# EasyEDA Pro project wukong01-Y003-HTOL - 2.eprj, board PCB1 (continued)
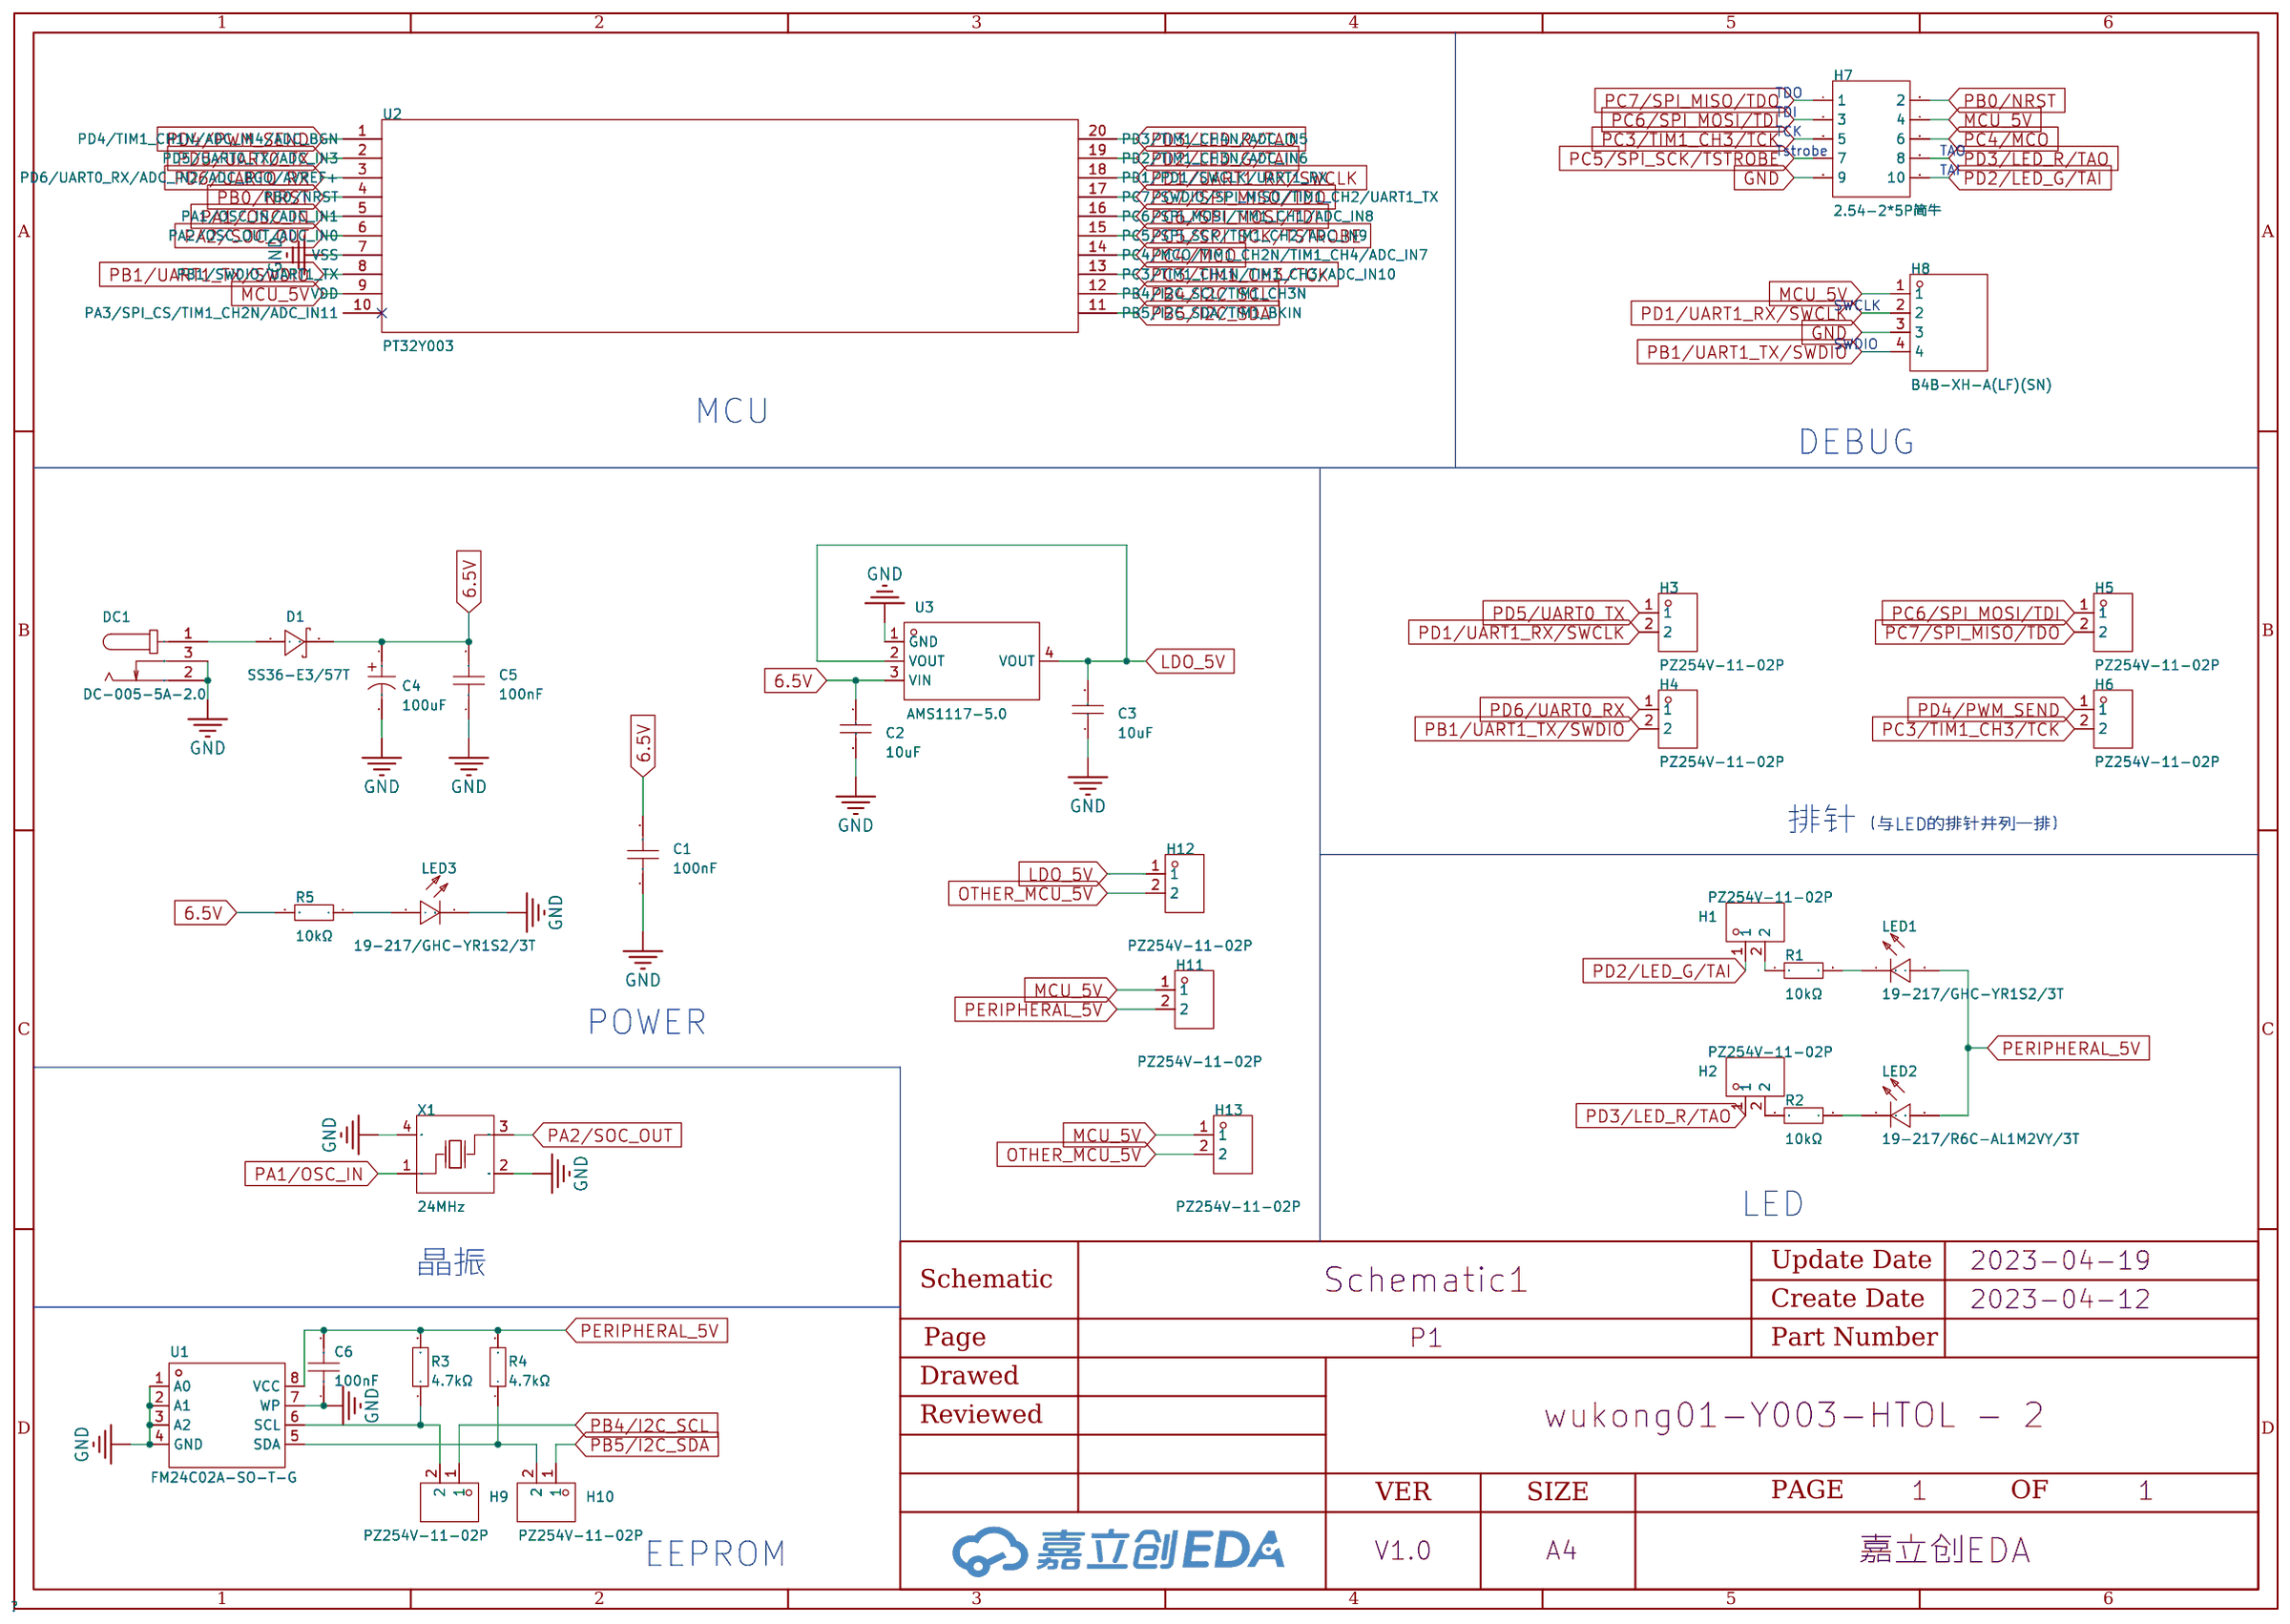
[diagram p0: schematic sheet]
## Routing (per net, layer and track width the routed paths; a pad name or vN(x,y) marks a point on that pad's centre or on a via; arc(x,y) is an arc through that point) (continued)
  Top Layer w0.254: U2#27.14 262.58,58.57 v1(269.32,58.57) ; v1(89.32,96.57) 82.58,96.57 U2#17.14 ; H7#12.6 124.67,141.81 v1(134.32,141.81) ; U2#32.14 217.58,20.57 v1(224.32,20.57) ; H7#13.6 169.67,141.81 v1(179.32,141.81) ; v1(44.32,103.8) 34.67,103.8 H7#21.6 ; v1(89.32,134.57) 82.58,134.57 U2#11.14 ; v1(134.32,210.57) 127.58,210.57 U2#2.14 ; 169.67,31.87 169.67,27.81 v1(179.32,27.81) ; U2#8.14 217.58,172.57 v1(224.32,172.57) ; v1(269.32,103.8) 259.67,103.8 H7#22.6 ; v1(89.32,210.57) 82.58,210.57 U2.14 ; H7#10.6 259.67,179.81 v1(269.32,179.81) ; v1(89.32,27.81) 79.67,27.81 79.67,31.87 ; H7#9.6 34.67,179.81 v1(44.32,179.81) ; H7#16.6 259.67,141.81 v1(269.32,141.81) ; v1(269.32,172.57) 262.58,172.57 U2#9.14 ; U2#31.14 172.58,20.57 v1(179.32,20.57) ; v1(44.32,141.81) 34.67,141.81 H7#15.6 ; H7#8.6 214.67,179.81 v1(224.32,179.81) ; v1(44.32,65.81) 34.67,65.81 34.67,69.87 ; v1(179.32,172.57) 172.58,172.57 U2#7.14 ; v1(224.32,58.57) 217.58,58.57 U2#26.14 ; H7#11.6 79.67,141.81 v1(89.32,141.81) ; v1(134.32,179.81) 124.67,179.81 H7#6.6 ; v1(179.32,58.57) 172.58,58.57 U2#25.14 ; v1(89.32,20.57) 82.58,20.57 U2#29.14 ; U2#6.14 127.58,172.57 v1(134.32,172.57) ; v1(89.32,103.8) 79.67,103.8 H7#17.6 ; v1(89.32,65.81) 79.67,65.81 79.67,69.87 ; v1(44.32,172.57) 37.58,172.57 U2#10.14 ; 169.67,221.87 169.67,217.81 v1(179.32,217.81) ; v1(224.32,65.81) 214.67,65.81 214.67,69.87 ; v1(179.32,96.57) 172.58,96.57 U2#19.14 ; v1(134.32,134.57) 127.58,134.57 U2#12.14 ; 79.67,221.87 79.67,217.81 v1(89.32,217.81) ; v1(44.32,96.57) 37.58,96.57 U2#22.14 ; v1(269.32,96.57) 262.58,96.57 U2#21.14 ; v1(224.32,217.81) 214.67,217.81 214.67,221.87 ; U2#4.14 217.58,210.57 v1(224.32,210.57) ; U2#23.14 82.58,58.57 v1(89.32,58.57) ; 124.67,31.87 124.67,27.81 v1(134.32,27.81) ; U2#18.14 127.58,96.57 v1(134.32,96.57) ; U2#24.14 127.58,58.57 v1(134.32,58.57) ; H7#19.6 169.67,103.8 v1(179.32,103.8) ; v1(44.32,58.57) 37.58,58.57 U2#28.14 ; v1(179.32,134.57) 172.58,134.57 U2#13.14 ; U2#20.14 217.58,96.57 v1(224.32,96.57) ; v1(179.32,179.81) 169.67,179.81 H7#7.6 ; v1(179.32,210.57) 172.58,210.57 U2#3.14 ; U2#14.14 217.58,134.57 v1(224.32,134.57) ; v1(134.32,217.81) 124.67,217.81 124.67,221.87 ; v1(224.32,27.81) 214.67,27.81 214.67,31.87 ; v1(89.32,172.57) 82.58,172.57 U2#5.14 ; v1(269.32,134.57) 262.58,134.57 U2#15.14 ; 259.67,69.87 259.67,65.81 v1(269.32,65.81) ; v1(134.32,65.81) 124.67,65.81 124.67,69.87 ; v1(134.32,20.57) 127.58,20.57 U2#30.14 ; v1(224.32,141.81) 214.67,141.81 H7#14.6 ; v1(179.32,65.81) 169.67,65.81 169.67,69.87 ; H7#18.6 124.67,103.8 v1(134.32,103.8) ; v1(89.32,179.81) 79.67,179.81 H7#5.6 ; U2#16.14 37.58,134.57 v1(44.32,134.57) ; H7#20.6 214.67,103.8 v1(224.32,103.8)
  Bottom Layer w0.254: v1(44.32,65.81) v1(44.32,58.57) ; v1(134.32,217.81) v1(134.32,210.57) ; v1(44.32,103.8) v1(44.32,96.57) ; v1(224.32,141.81) v1(224.32,134.57) ; v1(44.32,179.81) v1(44.32,172.57) ; v1(179.32,141.81) v1(179.32,134.57) ; v1(134.32,179.81) v1(134.32,172.57) ; v1(179.32,179.81) v1(179.32,172.57) ; v1(269.32,141.81) v1(269.32,134.57) ; v1(269.32,179.81) v1(269.32,172.57) ; v1(89.32,141.81) v1(89.32,134.57) ; v1(44.32,141.81) v1(44.32,134.57) ; v1(224.32,179.81) v1(224.32,172.57) ; v1(224.32,65.81) v1(224.32,58.57) ; v1(134.32,27.81) v1(134.32,20.57) ; v1(89.32,217.81) v1(89.32,210.57) ; v1(134.32,141.81) v1(134.32,134.57) ; v1(179.32,65.81) v1(179.32,58.57) ; v1(224.32,27.81) v1(224.32,20.57) ; v1(134.32,103.8) v1(134.32,96.57) ; v1(224.32,103.8) v1(224.32,96.57) ; v1(179.32,27.81) v1(179.32,20.57) ; v1(134.32,65.81) v1(134.32,58.57) ; v1(89.32,65.81) v1(89.32,58.57) ; v1(89.32,103.8) v1(89.32,96.57) ; v1(269.32,65.81) v1(269.32,58.57) ; v1(179.32,217.81) v1(179.32,210.57) ; v1(269.32,103.8) v1(269.32,96.57) ; v1(179.32,103.8) v1(179.32,96.57) ; v1(89.32,179.81) v1(89.32,172.57) ; v1(89.32,27.81) v1(89.32,20.57) ; v1(224.32,217.81) v1(224.32,210.57)
PC5/SPI_SCK/TSTROBE: length 1132
  Top Layer w0.254: v1(178.69,211.2) 172.6,211.2 U2#3.15 ; U2#8.15 217.6,173.2 v1(223.69,173.2) ; v1(268.69,135.2) 262.6,135.2 U2#15.15 ; v1(133.69,211.2) 127.6,211.2 U2#2.15 ; U2#17.15 82.6,97.2 v1(88.69,97.2) ; U2#9.15 262.6,173.2 v1(268.69,173.2) ; U2#30.15 127.6,21.2 v1(133.69,21.2) ; U2#11.15 82.6,135.2 v1(88.69,135.2) ; v1(133.69,173.2) 127.6,173.2 U2#6.15 ; U2#32.15 217.6,21.2 v1(223.69,21.2) ; U2.15 82.6,211.2 v1(88.69,211.2) ; U2#24.15 127.6,59.2 v1(133.69,59.2) ; U2#23.15 82.6,59.2 v1(88.69,59.2) ; U2#29.15 82.6,21.2 v1(88.69,21.2) ; v1(43.69,97.2) 37.6,97.2 U2#22.15 ; v1(223.69,211.2) 217.6,211.2 U2#4.15 ; v1(43.69,135.2) 37.6,135.2 U2#16.15 ; v1(133.69,135.2) 127.6,135.2 U2#12.15 ; U2#31.15 172.6,21.2 v1(178.69,21.2) ; v1(178.69,97.2) 172.6,97.2 U2#19.15 ; v1(178.69,135.2) 172.6,135.2 U2#13.15 ; v1(268.69,97.2) 262.6,97.2 U2#21.15 ; v1(43.69,59.2) 37.6,59.2 U2#28.15 ; U2#20.15 217.6,97.2 v1(223.69,97.2) ; U2#10.15 37.6,173.2 v1(43.69,173.2) ; v1(178.69,173.2) 172.6,173.2 U2#7.15 ; U2#26.15 217.6,59.2 v1(223.69,59.2) ; v1(133.69,97.2) 127.6,97.2 U2#18.15 ; U2#14.15 217.6,135.2 v1(223.69,135.2) ; U2#27.15 262.6,59.2 v1(268.69,59.2) ; U2#5.15 82.6,173.2 v1(88.69,173.2) ; v1(178.69,59.2) 172.6,59.2 U2#25.15
  Bottom Layer w0.254: v1(178.69,59.2) 178.69,74.31 177.93,75.08 167.89,75.08 167.13,74.31 H7#25.7 ; v1(178.69,97.2) 178.69,112.31 177.93,113.08 167.89,113.08 167.13,112.31 H7#19.7 ; v1(133.69,59.2) 133.69,74.31 132.93,75.08 122.89,75.08 122.13,74.31 H7#24.7 ; H7#13.7 167.13,150.31 167.89,151.08 177.93,151.08 178.69,150.31 v1(178.69,135.2) ; H7#5.7 77.13,188.31 77.89,189.08 87.93,189.08 88.69,188.31 v1(88.69,173.2) ; H7#29.7 77.13,36.31 77.89,37.08 87.93,37.08 88.69,36.31 v1(88.69,21.2) ; v1(43.69,173.2) 43.69,188.31 42.93,189.08 32.89,189.08 32.13,188.31 H7#9.7 ; H7#17.7 77.13,112.31 77.89,113.08 87.93,113.08 88.69,112.31 v1(88.69,97.2) ; H7#26.7 212.13,74.31 212.89,75.08 222.93,75.08 223.69,74.31 v1(223.69,59.2) ; v1(43.69,135.2) 43.69,150.31 42.93,151.08 32.89,151.08 32.13,150.31 H7#15.7 ; H7#20.7 212.13,112.31 212.89,113.08 222.93,113.08 223.69,112.31 v1(223.69,97.2) ; v1(268.69,135.2) 268.69,150.31 267.93,151.08 257.89,151.08 257.13,150.31 H7#16.7 ; v1(88.69,59.2) 88.69,74.31 87.93,75.08 77.89,75.08 77.13,74.31 H7#23.7 ; H7#8.7 212.13,188.31 212.89,189.08 222.93,189.08 223.69,188.31 v1(223.69,173.2) ; H7.7 77.13,226.31 77.89,227.08 87.93,227.08 88.69,226.31 v1(88.69,211.2) ; v1(178.69,173.2) 178.69,188.31 177.93,189.08 167.89,189.08 167.13,188.31 H7#7.7 ; H7#21.7 32.13,112.31 32.89,113.08 42.93,113.08 43.69,112.31 v1(43.69,97.2) ; v1(268.69,173.2) 268.69,188.31 267.93,189.08 257.89,189.08 257.13,188.31 H7#10.7 ; H7#14.7 212.13,150.31 212.89,151.08 222.93,151.08 223.69,150.31 v1(223.69,135.2) ; v1(223.69,211.2) 223.69,226.31 222.93,227.08 212.89,227.08 212.13,226.31 H7#4.7 ; H7#6.7 122.13,188.31 122.89,189.08 132.93,189.08 133.69,188.31 v1(133.69,173.2) ; H7#32.7 212.13,36.31 212.89,37.08 222.93,37.08 223.69,36.31 v1(223.69,21.2) ; H7#31.7 167.13,36.31 167.89,37.08 177.93,37.08 178.69,36.31 v1(178.69,21.2) ; v1(133.69,211.2) 133.69,226.31 132.93,227.08 122.89,227.08 122.13,226.31 H7#2.7 ; v1(133.69,21.2) 133.69,36.31 132.93,37.08 122.89,37.08 122.13,36.31 H7#30.7 ; v1(43.69,59.2) 43.69,74.31 42.93,75.08 32.89,75.08 32.13,74.31 H7#27.7 ; H7#12.7 122.13,150.31 122.89,151.08 132.93,151.08 133.69,150.31 v1(133.69,135.2) ; H7#11.7 77.13,150.31 77.89,151.08 87.93,151.08 88.69,150.31 v1(88.69,135.2) ; H7#22.7 257.13,112.31 257.89,113.08 267.93,113.08 268.69,112.31 v1(268.69,97.2) ; v1(268.69,59.2) 268.69,74.31 267.93,75.08 257.89,75.08 257.13,74.31 H7#28.7 ; H7#3.7 167.13,226.31 167.89,227.08 177.93,227.08 178.69,226.31 v1(178.69,211.2) ; H7#18.7 122.13,112.31 122.89,113.08 132.93,113.08 133.69,112.31 v1(133.69,97.2)
PC6/SPI_MOSI/TDI: length 1011.1
  Top Layer w0.254: U2#23.16 82.6,59.96 v1(88.05,59.96) 92.12,59.96 92.75,60.6 H5#25.1 ; H5#11.1 227.75,136.6 227.12,135.96 v1(223.05,135.96) 217.6,135.96 U2#14.16 ; U2#24.16 127.6,59.96 v1(133.05,59.96) 137.12,59.96 137.75,60.6 H5#24.1 ; U2#25.16 172.6,59.96 v1(178.05,59.96) 182.12,59.96 182.75,60.6 H5#26.1 ; H5#7.1 92.75,174.6 92.12,173.96 v1(88.05,173.96) 82.6,173.96 U2#5.16 ; U2#28.16 37.6,59.96 v1(43.05,59.96) 47.12,59.96 47.75,60.6 H5#28.1 ; U2#9.16 262.6,173.96 v1(268.05,173.96) 272.12,173.96 272.75,174.6 H5#9.1 ; U2#11.16 82.6,135.96 v1(88.05,135.96) 92.12,135.96 92.75,136.6 H5#13.1 ; H5#22.1 47.75,98.6 47.12,97.96 v1(43.05,97.96) 37.6,97.96 U2#22.16 ; H5#6.1 137.75,174.6 137.12,173.96 v1(133.05,173.96) 127.6,173.96 U2#6.16 ; H5#8.1 182.75,174.6 182.12,173.96 v1(178.05,173.96) 172.6,173.96 U2#7.16 ; U2#3.16 172.6,211.96 v1(178.05,211.96) 182.12,211.96 182.75,212.6 H5#4.1 ; U2#18.16 127.6,97.96 v1(133.05,97.96) 137.12,97.96 137.75,98.6 H5#18.1 ; U2#17.16 82.6,97.96 v1(88.05,97.96) 92.12,97.96 92.75,98.6 H5#19.1 ; U2#12.16 127.6,135.96 v1(133.05,135.96) 137.12,135.96 137.75,136.6 H5#12.1 ; U2#2.16 127.6,211.96 v1(133.05,211.96) 137.12,211.96 137.75,212.6 H5#3.1 ; U2#32.16 217.6,21.96 v1(223.05,21.96) 227.12,21.96 227.75,22.6 H5#29.1 ; H5#16.1 47.75,136.6 47.12,135.96 v1(43.05,135.96) 37.6,135.96 U2#16.16 ; U2#10.16 37.6,173.96 v1(43.05,173.96) 47.12,173.96 47.75,174.6 H5#10.1 ; U2#27.16 262.6,59.96 v1(268.05,59.96) 272.12,59.96 272.75,60.6 H5#27.1 ; H5#17.1 227.75,98.6 227.12,97.96 v1(223.05,97.96) 217.6,97.96 U2#20.16 ; H5#32.1 182.75,22.6 182.12,21.96 v1(178.05,21.96) 172.6,21.96 U2#31.16 ; H5#21.1 272.75,98.6 272.12,97.96 v1(268.05,97.96) 262.6,97.96 U2#21.16 ; H5#23.1 227.75,60.6 227.12,59.96 v1(223.05,59.96) 217.6,59.96 U2#26.16 ; U2#4.16 217.6,211.96 v1(223.05,211.96) 227.12,211.96 227.75,212.6 H5.1 ; H5#31.1 92.75,22.6 92.12,21.96 v1(88.05,21.96) 82.6,21.96 U2#29.16 ; H5#2.1 92.75,212.6 92.12,211.96 v1(88.05,211.96) 82.6,211.96 U2.16 ; U2#15.16 262.6,135.96 v1(268.05,135.96) 272.12,135.96 272.75,136.6 H5#15.1 ; H5#20.1 182.75,98.6 182.12,97.96 v1(178.05,97.96) 172.6,97.96 U2#19.16 ; H5#14.1 182.75,136.6 182.12,135.96 v1(178.05,135.96) 172.6,135.96 U2#13.16 ; H5#5.1 227.75,174.6 227.12,173.96 v1(223.05,173.96) 217.6,173.96 U2#8.16 ; U2#30.16 127.6,21.96 v1(133.05,21.96) 137.12,21.96 137.75,22.6 H5#30.1
  Bottom Layer w0.254: H7#6.3 127.21,187.17 127.85,187.81 132.42,187.81 133.05,187.17 v1(133.05,173.96) ; H7#4.3 217.21,225.17 217.85,225.81 222.42,225.81 223.05,225.17 v1(223.05,211.96) ; v1(223.05,21.96) 223.05,35.17 222.42,35.81 217.85,35.81 217.21,35.17 H7#32.3 ; H7#19.3 172.21,111.17 172.85,111.81 177.42,111.81 178.05,111.17 v1(178.05,97.96) ; H7#15.3 37.21,149.17 37.85,149.81 42.42,149.81 43.05,149.17 v1(43.05,135.96) ; v1(268.05,97.96) 268.05,111.17 267.42,111.81 262.85,111.81 262.21,111.17 H7#22.3 ; v1(133.05,21.96) 133.05,35.17 132.42,35.81 127.85,35.81 127.21,35.17 H7#30.3 ; v1(268.05,59.96) 268.05,73.17 267.42,73.81 262.85,73.81 262.21,73.17 H7#28.3 ; H7#10.3 262.21,187.17 262.85,187.81 267.42,187.81 268.05,187.17 v1(268.05,173.96) ; v1(88.05,97.96) 88.05,111.17 87.42,111.81 82.85,111.81 82.21,111.17 H7#17.3 ; H7#12.3 127.21,149.17 127.85,149.81 132.42,149.81 133.05,149.17 v1(133.05,135.96) ; H7#31.3 172.21,35.17 172.85,35.81 177.42,35.81 178.05,35.17 v1(178.05,21.96) ; H7#25.3 172.21,73.17 172.85,73.81 177.42,73.81 178.05,73.17 v1(178.05,59.96) ; v1(43.05,59.96) 43.05,73.17 42.42,73.81 37.85,73.81 37.21,73.17 H7#27.3 ; v1(178.05,135.96) 178.05,149.17 177.42,149.81 172.85,149.81 172.21,149.17 H7#13.3 ; v1(223.05,59.96) 223.05,73.17 222.42,73.81 217.85,73.81 217.21,73.17 H7#26.3 ; H7#11.3 82.21,149.17 82.85,149.81 87.42,149.81 88.05,149.17 v1(88.05,135.96) ; v1(223.05,97.96) 223.05,111.17 222.42,111.81 217.85,111.81 217.21,111.17 H7#20.3 ; v1(223.05,173.96) 223.05,187.17 222.42,187.81 217.85,187.81 217.21,187.17 H7#8.3 ; v1(133.05,97.96) 133.05,111.17 132.42,111.81 127.85,111.81 127.21,111.17 H7#18.3 ; H7#5.3 82.21,187.17 82.85,187.81 87.42,187.81 88.05,187.17 v1(88.05,173.96) ; H7#16.3 262.21,149.17 262.85,149.81 267.42,149.81 268.05,149.17 v1(268.05,135.96) ; H7#23.3 82.21,73.17 82.85,73.81 87.42,73.81 88.05,73.17 v1(88.05,59.96) ; H7#2.3 127.21,225.17 127.85,225.81 132.42,225.81 133.05,225.17 v1(133.05,211.96) ; H7#14.3 217.21,149.17 217.85,149.81 222.42,149.81 223.05,149.17 v1(223.05,135.96) ; v1(43.05,97.96) 43.05,111.17 42.42,111.81 37.85,111.81 37.21,111.17 H7#21.3 ; v1(178.05,173.96) 178.05,187.17 177.42,187.81 172.85,187.81 172.21,187.17 H7#7.3 ; H7#29.3 82.21,35.17 82.85,35.81 87.42,35.81 88.05,35.17 v1(88.05,21.96) ; H7#3.3 172.21,225.17 172.85,225.81 177.42,225.81 178.05,225.17 v1(178.05,211.96) ; v1(133.05,59.96) 133.05,73.17 132.42,73.81 127.85,73.81 127.21,73.17 H7#24.3 ; v1(88.05,211.96) 88.05,225.17 87.42,225.81 82.85,225.81 82.21,225.17 H7.3 ; v1(43.05,173.96) 43.05,187.17 42.42,187.81 37.85,187.81 37.21,187.17 H7#9.3
PC7/SPI_MISO/TDO: length 1663.7
  Top Layer w0.254: U2#23.17 82.58,60.6 v1(87.42,60.6) ; U2#10.17 37.58,174.6 v1(42.42,174.6) ; v1(42.42,60.6) 37.58,60.6 U2#28.17 ; U2#3.17 172.58,212.6 v1(177.42,212.6) ; U2#25.17 172.58,60.6 v1(177.42,60.6) ; U2#17.17 82.58,98.6 v1(87.42,98.6) ; U2#21.17 262.58,98.6 v1(267.42,98.6) ; v1(132.42,174.6) 127.58,174.6 U2#6.17 ; v1(222.42,174.6) 217.58,174.6 U2#8.17 ; U2#20.17 217.58,98.6 v1(222.42,98.6) ; v1(132.42,212.6) 127.58,212.6 U2#2.17 ; v1(222.42,212.6) 217.58,212.6 U2#4.17 ; U2#19.17 172.58,98.6 v1(177.42,98.6) ; U2#32.17 217.58,22.6 v1(222.42,22.6) ; U2#31.17 172.58,22.6 v1(177.42,22.6) ; U2#30.17 127.58,22.6 v1(132.42,22.6) ; U2#26.17 217.58,60.6 v1(222.42,60.6) ; U2#15.17 262.58,136.6 v1(267.42,136.6) ; U2#14.17 217.58,136.6 v1(222.42,136.6) ; v1(132.42,98.6) 127.58,98.6 U2#18.17 ; v1(267.42,174.6) 262.58,174.6 U2#9.17 ; U2#16.17 37.58,136.6 v1(42.42,136.6) ; v1(267.42,60.6) 262.58,60.6 U2#27.17 ; U2#5.17 82.58,174.6 v1(87.42,174.6) ; v1(87.42,136.6) 82.58,136.6 U2#11.17 ; U2#12.17 127.58,136.6 v1(132.42,136.6) ; v1(42.42,98.6) 37.58,98.6 U2#22.17 ; U2#13.17 172.58,136.6 v1(177.42,136.6) ; U2#24.17 127.58,60.6 v1(132.42,60.6) ; U2#29.17 82.58,22.6 v1(87.42,22.6) ; U2.17 82.58,212.6 v1(87.42,212.6) ; U2#7.17 172.58,174.6 v1(177.42,174.6)
  Bottom Layer w0.254: 84.75,224.41 86.66,224.41 87.42,223.65 v1(87.42,212.6) 87.42,210.44 91.1,206.76 91.1,201.29 91.48,200.91 97.2,200.91 98.59,202.31 98.59,211.2 97.2,212.6 H5#2.2 ; H7#12.1 131.66,148.41 132.42,147.65 v1(132.42,136.6) 132.42,134.44 136.1,130.76 136.1,125.29 136.48,124.91 142.2,124.91 143.59,126.31 143.59,135.2 142.2,136.6 H5#12.2 ; H5#23.2 232.2,60.6 233.59,59.2 233.59,50.31 232.2,48.91 226.48,48.91 226.1,49.29 226.1,54.76 222.42,58.44 v1(222.42,60.6) 222.42,71.65 221.66,72.41 H7#26.1 ; H5#15.2 277.2,136.6 278.59,135.2 278.59,126.31 277.2,124.91 271.48,124.91 271.1,125.29 271.1,130.76 267.42,134.44 v1(267.42,136.6) 267.42,147.65 266.66,148.41 H7#16.1 ; H5#4.2 187.2,212.6 188.59,211.2 188.59,202.31 187.2,200.91 181.48,200.91 181.1,201.29 181.1,206.76 177.42,210.44 v1(177.42,212.6) 177.42,223.65 176.66,224.41 174.75,224.41 ; H5#22.2 52.2,98.6 53.59,97.2 53.59,88.31 52.2,86.91 46.48,86.91 46.1,87.29 46.1,92.76 42.42,96.44 v1(42.42,98.6) 42.42,109.65 41.66,110.41 H7#21.1 ; H7#22.1 266.66,110.41 267.42,109.65 v1(267.42,98.6) 267.42,96.44 271.1,92.76 271.1,87.29 271.48,86.91 277.2,86.91 278.59,88.31 278.59,97.2 277.2,98.6 H5#21.2 ; H5#6.2 142.2,174.6 143.59,173.2 143.59,164.31 142.2,162.91 136.48,162.91 136.1,163.29 136.1,168.76 132.42,172.44 v1(132.42,174.6) 132.42,185.65 131.66,186.41 H7#6.1 ; H5#14.2 187.2,136.6 188.59,135.2 188.59,126.31 187.2,124.91 181.48,124.91 181.1,125.29 181.1,130.76 177.42,134.44 v1(177.42,136.6) 177.42,147.65 176.66,148.41 H7#13.1 ; H7#11.1 86.66,148.41 87.42,147.65 v1(87.42,136.6) 87.42,134.44 91.1,130.76 91.1,125.29 91.48,124.91 97.2,124.91 98.59,126.31 98.59,135.2 97.2,136.6 H5#13.2 ; 129.75,224.41 131.66,224.41 132.42,223.65 v1(132.42,212.6) 132.42,210.44 136.1,206.76 136.1,201.29 136.48,200.91 142.2,200.91 143.59,202.31 143.59,211.2 142.2,212.6 H5#3.2 ; H5#25.2 97.2,60.6 98.59,59.2 98.59,50.31 97.2,48.91 91.48,48.91 91.1,49.29 91.1,54.76 87.42,58.44 v1(87.42,60.6) 87.42,71.65 86.66,72.41 H7#23.1 ; H5#7.2 97.2,174.6 98.59,173.2 98.59,164.31 97.2,162.91 91.48,162.91 91.1,163.29 91.1,168.76 87.42,172.44 v1(87.42,174.6) 87.42,185.65 86.66,186.41 H7#5.1 ; H7#15.1 41.66,148.41 42.42,147.65 v1(42.42,136.6) 42.42,134.44 46.1,130.76 46.1,125.29 46.48,124.91 52.2,124.91 53.59,126.31 53.59,135.2 52.2,136.6 H5#16.2 ; H5#10.2 52.2,174.6 53.59,173.2 53.59,164.31 52.2,162.91 46.48,162.91 46.1,163.29 46.1,168.76 42.42,172.44 v1(42.42,174.6) 42.42,185.65 41.66,186.41 H7#9.1 ; 219.75,224.41 221.66,224.41 222.42,223.65 v1(222.42,212.6) 222.42,210.44 226.1,206.76 226.1,201.29 226.48,200.91 232.2,200.91 233.59,202.31 233.59,211.2 232.2,212.6 H5.2 ; H5#9.2 277.2,174.6 278.59,173.2 278.59,164.31 277.2,162.91 271.48,162.91 271.1,163.29 271.1,168.76 267.42,172.44 v1(267.42,174.6) 267.42,185.65 266.66,186.41 H7#10.1 ; H5#19.2 97.2,98.6 98.59,97.2 98.59,88.31 97.2,86.91 91.48,86.91 91.1,87.29 91.1,92.76 87.42,96.44 v1(87.42,98.6) 87.42,109.65 86.66,110.41 H7#17.1 ; H7#18.1 131.66,110.41 132.42,109.65 v1(132.42,98.6) 132.42,96.44 136.1,92.76 136.1,87.29 136.48,86.91 142.2,86.91 143.59,88.31 143.59,97.2 142.2,98.6 H5#18.2 ; H5#5.2 232.2,174.6 233.59,173.2 233.59,164.31 232.2,162.91 226.48,162.91 226.1,163.29 226.1,168.76 222.42,172.44 v1(222.42,174.6) 222.42,185.65 221.66,186.41 H7#8.1 ; H7#31.1 176.66,34.41 177.42,33.65 v1(177.42,22.6) 177.42,20.44 181.1,16.76 181.1,11.29 181.48,10.91 187.2,10.91 188.59,12.31 188.59,21.2 187.2,22.6 H5#32.2 ; H5#27.2 277.2,60.6 278.59,59.2 278.59,50.31 277.2,48.91 271.48,48.91 271.1,49.29 271.1,54.76 267.42,58.44 v1(267.42,60.6) 267.42,71.65 266.66,72.41 H7#28.1 ; H7#7.1 176.66,186.41 177.42,185.65 v1(177.42,174.6) 177.42,172.44 181.1,168.76 181.1,163.29 181.48,162.91 187.2,162.91 188.59,164.31 188.59,173.2 187.2,174.6 H5#8.2 ; H5#31.2 97.2,22.6 98.59,21.2 98.59,12.31 97.2,10.91 91.48,10.91 91.1,11.29 91.1,16.76 87.42,20.44 v1(87.42,22.6) 87.42,33.65 86.66,34.41 H7#29.1 ; H7#20.1 221.66,110.41 222.42,109.65 v1(222.42,98.6) 222.42,96.44 226.1,92.76 226.1,87.29 226.48,86.91 232.2,86.91 233.59,88.31 233.59,97.2 232.2,98.6 H5#17.2 ; H5#24.2 142.2,60.6 143.59,59.2 143.59,50.31 142.2,48.91 136.48,48.91 136.1,49.29 136.1,54.76 132.42,58.44 v1(132.42,60.6) 132.42,71.65 131.66,72.41 H7#24.1 ; H7#25.1 176.66,72.41 177.42,71.65 v1(177.42,60.6) 177.42,58.44 181.1,54.76 181.1,49.29 181.48,48.91 187.2,48.91 188.59,50.31 188.59,59.2 187.2,60.6 H5#26.2 ; H5#11.2 232.2,136.6 233.59,135.2 233.59,126.31 232.2,124.91 226.48,124.91 226.1,125.29 226.1,130.76 222.42,134.44 v1(222.42,136.6) 222.42,147.65 221.66,148.41 H7#14.1 ; H5#30.2 142.2,22.6 143.59,21.2 143.59,12.31 142.2,10.91 136.48,10.91 136.1,11.29 136.1,16.76 132.42,20.44 v1(132.42,22.6) 132.42,33.65 131.66,34.41 H7#30.1 ; H7#27.1 41.66,72.41 42.42,71.65 v1(42.42,60.6) 42.42,58.44 46.1,54.76 46.1,49.29 46.48,48.91 52.2,48.91 53.59,50.31 53.59,59.2 52.2,60.6 H5#28.2 ; H7#32.1 221.66,34.41 222.42,33.65 v1(222.42,22.6) 222.42,20.44 226.1,16.76 226.1,11.29 226.48,10.91 232.2,10.91 233.59,12.31 233.59,21.2 232.2,22.6 H5#29.2 ; H5#20.2 187.2,98.6 188.59,97.2 188.59,88.31 187.2,86.91 181.48,86.91 181.1,87.29 181.1,92.76 177.42,96.44 v1(177.42,98.6) 177.42,109.65 176.66,110.41 H7#19.1
PD1/UART1_RX/SWCLK: length 2085.1
  Top Layer w0.254: v1(176.78,137.23) 172.57,137.23 U2#13.18 ; U2#31.18 172.57,23.23 v1(176.78,23.23) ; v1(131.78,152.22) v1(131.78,146.88) ; v1(266.78,61.23) 262.57,61.23 U2#27.18 ; v1(86.78,175.23) 82.57,175.23 U2#5.18 ; v1(221.78,38.22) v1(221.78,32.88) ; v1(176.78,152.22) v1(176.78,146.88) ; v1(41.78,175.23) 37.57,175.23 U2#10.18 ; U2#18.18 127.57,99.23 v1(131.78,99.23) ; v1(131.78,190.22) v1(131.78,184.88) ; U2#32.18 217.57,23.23 v1(221.78,23.23) ; U2#15.18 262.57,137.23 v1(266.78,137.23) ; U2#29.18 82.57,23.23 v1(86.78,23.23) ; U2#25.18 172.57,61.23 v1(176.78,61.23) ; v1(176.78,228.22) v1(176.78,222.88) ; U2#24.18 127.57,61.23 v1(131.78,61.23) ; U2#4.18 217.57,213.23 v1(221.78,213.23) ; v1(131.78,228.22) v1(131.78,222.88) ; v1(41.78,99.23) 37.57,99.23 U2#22.18 ; U2#20.18 217.57,99.23 v1(221.78,99.23) ; v1(86.78,38.22) v1(86.78,32.88) ; v1(131.78,23.23) 127.57,23.23 U2#30.18 ; v1(176.78,38.22) v1(176.78,32.88) ; v1(221.78,152.22) v1(221.78,146.88) ; v1(131.78,76.22) v1(131.78,70.88) ; U2#7.18 172.57,175.23 v1(176.78,175.23) ; v1(221.78,190.22) v1(221.78,184.88) ; U2.18 82.57,213.23 v1(86.78,213.23) ; v1(131.78,213.23) 127.57,213.23 U2#2.18 ; v1(266.78,152.22) v1(266.78,146.88) ; U2#6.18 127.57,175.23 v1(131.78,175.23) ; v1(131.78,137.23) 127.57,137.23 U2#12.18 ; v1(41.78,76.22) v1(41.78,70.88) ; U2#16.18 37.57,137.23 v1(41.78,137.23) ; v1(266.78,190.22) v1(266.78,184.88) ; v1(41.78,61.23) 37.57,61.23 U2#28.18 ; v1(131.78,114.22) v1(131.78,108.88) ; v1(266.78,114.22) v1(266.78,108.88) ; v1(266.78,76.22) v1(266.78,70.88) ; v1(176.78,76.22) v1(176.78,70.88) ; U2#23.18 82.57,61.23 v1(86.78,61.23) ; v1(86.78,228.22) v1(86.78,222.88) ; v1(176.78,190.22) v1(176.78,184.88) ; v1(221.78,61.23) 217.57,61.23 U2#26.18 ; U2#11.18 82.57,137.23 v1(86.78,137.23) ; U2#17.18 82.57,99.23 v1(86.78,99.23) ; v1(221.78,228.22) v1(221.78,222.88) ; v1(86.78,190.22) v1(86.78,184.88) ; U2#9.18 262.57,175.23 v1(266.78,175.23) ; v1(221.78,76.22) v1(221.78,70.88) ; v1(41.78,152.22) v1(41.78,146.88) ; v1(86.78,152.22) v1(86.78,146.88) ; v1(176.78,99.23) 172.57,99.23 U2#19.18 ; v1(176.78,213.23) 172.57,213.23 U2#3.18 ; v1(131.78,38.22) v1(131.78,32.88) ; v1(41.78,114.22) v1(41.78,108.88) ; U2#21.18 262.57,99.23 v1(266.78,99.23) ; v1(86.78,76.22) v1(86.78,70.88) ; v1(176.78,114.22) v1(176.78,108.88) ; v1(41.78,190.22) v1(41.78,184.88) ; U2#14.18 217.57,137.23 v1(221.78,137.23) ; v1(221.78,114.22) v1(221.78,108.88) ; v1(86.78,114.22) v1(86.78,108.88) ; v1(221.78,175.23) 217.57,175.23 U2#8.18
  Bottom Layer w0.254: H3#25.2 232.32,70.76 233.09,71.52 233.09,75.46 232.32,76.22 v1(221.78,76.22) 204.38,76.22 203.37,75.2 203.37,70 202.35,68.98 H8#25.2 ; H8#16.2 247.35,144.98 248.37,146 248.37,151.2 249.38,152.22 v1(266.78,152.22) 277.32,152.22 278.09,151.46 278.09,147.52 277.32,146.76 H3#16.2 ; v1(86.78,70.88) v1(86.78,61.23) ; H8#17.2 67.35,106.98 68.37,108 68.37,113.2 69.38,114.22 v1(86.78,114.22) 97.32,114.22 98.09,113.46 98.09,109.52 97.32,108.76 H3#18.2 ; v1(131.78,32.88) v1(131.78,23.23) ; v1(176.78,146.88) v1(176.78,137.23) ; v1(221.78,222.88) v1(221.78,213.23) ; H8#23.2 67.35,68.98 68.37,70 68.37,75.2 69.38,76.22 v1(86.78,76.22) 97.32,76.22 98.09,75.46 98.09,71.52 97.32,70.76 H3#24.2 ; v1(131.78,184.88) v1(131.78,175.23) ; H8#15.2 157.35,144.98 158.37,146 158.37,151.2 159.38,152.22 v1(176.78,152.22) 187.32,152.22 188.09,151.46 188.09,147.52 187.32,146.76 H3#15.2 ; H8#11.2 67.35,144.98 68.37,146 68.37,151.2 69.38,152.22 v1(86.78,152.22) 97.32,152.22 98.09,151.46 98.09,147.52 97.32,146.76 H3#11.2 ; v1(41.78,146.88) v1(41.78,137.23) ; v1(266.78,108.88) v1(266.78,99.23) ; v1(41.78,70.88) v1(41.78,61.23) ; H3#9.2 277.32,184.76 278.09,185.52 278.09,189.46 277.32,190.22 v1(266.78,190.22) 249.38,190.22 248.37,189.2 248.37,184 247.35,182.98 H8#10.2 ; H8#7.2 202.35,182.98 203.37,184 203.37,189.2 204.38,190.22 v1(221.78,190.22) 232.32,190.22 233.09,189.46 233.09,185.52 232.32,184.76 H3#6.2 ; H8#9.2 157.35,182.98 158.37,184 158.37,189.2 159.38,190.22 v1(176.78,190.22) 187.32,190.22 188.09,189.46 188.09,185.52 187.32,184.76 H3#8.2 ; v1(131.78,108.88) v1(131.78,99.23) ; H3#13.2 232.32,146.76 233.09,147.52 233.09,151.46 232.32,152.22 v1(221.78,152.22) 204.38,152.22 203.37,151.2 203.37,146 202.35,144.98 H8#13.2 ; v1(86.78,146.88) v1(86.78,137.23) ; v1(176.78,70.88) v1(176.78,61.23) ; H3.2 97.32,222.76 98.09,223.52 98.09,227.46 97.32,228.22 v1(86.78,228.22) 69.38,228.22 68.37,227.2 68.37,222 67.35,220.98 H8.2 ; H3#27.2 277.32,70.76 278.09,71.52 278.09,75.46 277.32,76.22 v1(266.78,76.22) 249.38,76.22 248.37,75.2 248.37,70 247.35,68.98 H8#28.2 ; v1(266.78,184.88) v1(266.78,175.23) ; H3#10.2 52.32,184.76 53.09,185.52 53.09,189.46 52.32,190.22 v1(41.78,190.22) 24.38,190.22 23.37,189.2 23.37,184 22.35,182.98 H8#8.2 ; v1(176.78,108.88) v1(176.78,99.23) ; H3#12.2 142.32,70.76 143.09,71.52 143.09,75.46 142.32,76.22 v1(131.78,76.22) 114.38,76.22 113.37,75.2 113.37,70 112.35,68.98 H8#24.2 ; H8#20.2 22.35,106.98 23.37,108 23.37,113.2 24.38,114.22 v1(41.78,114.22) 52.32,114.22 53.09,113.46 53.09,109.52 52.32,108.76 H3#23.2 ; v1(86.78,184.88) v1(86.78,175.23) ; H3#29.2 97.32,32.76 98.09,33.52 98.09,37.46 97.32,38.22 v1(86.78,38.22) 69.38,38.22 68.37,37.2 68.37,32 67.35,30.98 H8#29.2 ; H3#7.2 142.32,184.76 143.09,185.52 143.09,189.46 142.32,190.22 v1(131.78,190.22) 114.38,190.22 113.37,189.2 113.37,184 112.35,182.98 H8#6.2 ; H8#2.2 112.35,220.98 113.37,222 113.37,227.2 114.38,228.22 v1(131.78,228.22) 142.32,228.22 143.09,227.46 143.09,223.52 142.32,222.76 H3#2.2 ; H8#31.2 202.35,30.98 203.37,32 203.37,37.2 204.38,38.22 v1(221.78,38.22) 232.32,38.22 233.09,37.46 233.09,33.52 232.32,32.76 H3#30.2 ; H8#26.2 22.35,68.98 23.37,70 23.37,75.2 24.38,76.22 v1(41.78,76.22) 52.32,76.22 53.09,75.46 53.09,71.52 52.32,70.76 H3#28.2 ; H8#22.2 247.35,106.98 248.37,108 248.37,113.2 249.38,114.22 v1(266.78,114.22) 277.32,114.22 278.09,113.46 278.09,109.52 277.32,108.76 H3#22.2 ; H8#3.2 157.35,220.98 158.37,222 158.37,227.2 159.38,228.22 v1(176.78,228.22) 187.32,228.22 188.09,227.46 188.09,223.52 187.32,222.76 H3#3.2 ; v1(221.78,184.88) v1(221.78,175.23) ; v1(266.78,146.88) v1(266.78,137.23) ; H8#27.2 157.35,68.98 158.37,70 158.37,75.2 159.38,76.22 v1(176.78,76.22) 187.32,76.22 188.09,75.46 188.09,71.52 187.32,70.76 H3#26.2 ; H8#14.2 22.35,144.98 23.37,146 23.37,151.2 24.38,152.22 v1(41.78,152.22) 52.32,152.22 53.09,151.46 53.09,147.52 52.32,146.76 H3#17.2 ; H8#4.2 202.35,220.98 203.37,222 203.37,227.2 204.38,228.22 v1(221.78,228.22) 232.32,228.22 233.09,227.46 233.09,223.52 232.32,222.76 H3#4.2 ; v1(131.78,70.88) v1(131.78,61.23) ; v1(131.78,222.88) v1(131.78,213.23) ; v1(41.78,184.88) v1(41.78,175.23) ; H3#5.2 97.32,184.76 98.09,185.52 98.09,189.46 97.32,190.22 v1(86.78,190.22) 69.38,190.22 68.37,189.2 68.37,184 67.35,182.98 H8#5.2 ; H8#21.2 157.35,106.98 158.37,108 158.37,113.2 159.38,114.22 v1(176.78,114.22) 187.32,114.22 188.09,113.46 188.09,109.52 187.32,108.76 H3#21.2 ; H3#31.2 142.32,32.76 143.09,33.52 143.09,37.46 142.32,38.22 v1(131.78,38.22) 114.38,38.22 113.37,37.2 113.37,32 112.35,30.98 H8#30.2 ; H3#14.2 142.32,146.76 143.09,147.52 143.09,151.46 142.32,152.22 v1(131.78,152.22) 114.38,152.22 113.37,151.2 113.37,146 112.35,144.98 H8#12.2 ; v1(221.78,70.88) v1(221.78,61.23) ; H3#19.2 232.32,108.76 233.09,109.52 233.09,113.46 232.32,114.22 v1(221.78,114.22) 204.38,114.22 203.37,113.2 203.37,108 202.35,106.98 H8#19.2 ; v1(41.78,108.88) v1(41.78,99.23) ; v1(176.78,222.88) v1(176.78,213.23) ; v1(86.78,222.88) v1(86.78,213.23) ; v1(176.78,184.88) v1(176.78,175.23) ; H8#32.2 157.35,30.98 158.37,32 158.37,37.2 159.38,38.22 v1(176.78,38.22) 187.32,38.22 188.09,37.46 188.09,33.52 187.32,32.76 H3#32.2 ; v1(221.78,108.88) v1(221.78,99.23) ; H3#20.2 142.32,108.76 143.09,109.52 143.09,113.46 142.32,114.22 v1(131.78,114.22) 114.38,114.22 113.37,113.2 113.37,108 112.35,106.98 H8#18.2 ; v1(221.78,146.88) v1(221.78,137.23) ; v1(86.78,108.88) v1(86.78,99.23) ; v1(176.78,32.88) v1(176.78,23.23) ; v1(86.78,32.88) v1(86.78,23.23) ; v1(131.78,146.88) v1(131.78,137.23) ; v1(221.78,32.88) v1(221.78,23.23) ; v1(266.78,70.88) v1(266.78,61.23)
